# EasyEDA Pro project Arduino UNO DIY.eprj, schematic Schematic1
Board Name: Arduino UNO DIY; Create Date: 2025-09-15; Page Name: P1; Project Name: Arduino UNO DIY; Schematic Name: Schematic1; Update Date: 2025-09-24; Company: m039; Drawn: Dmitry Mozgin; Page Size: A4; Version: V1.0
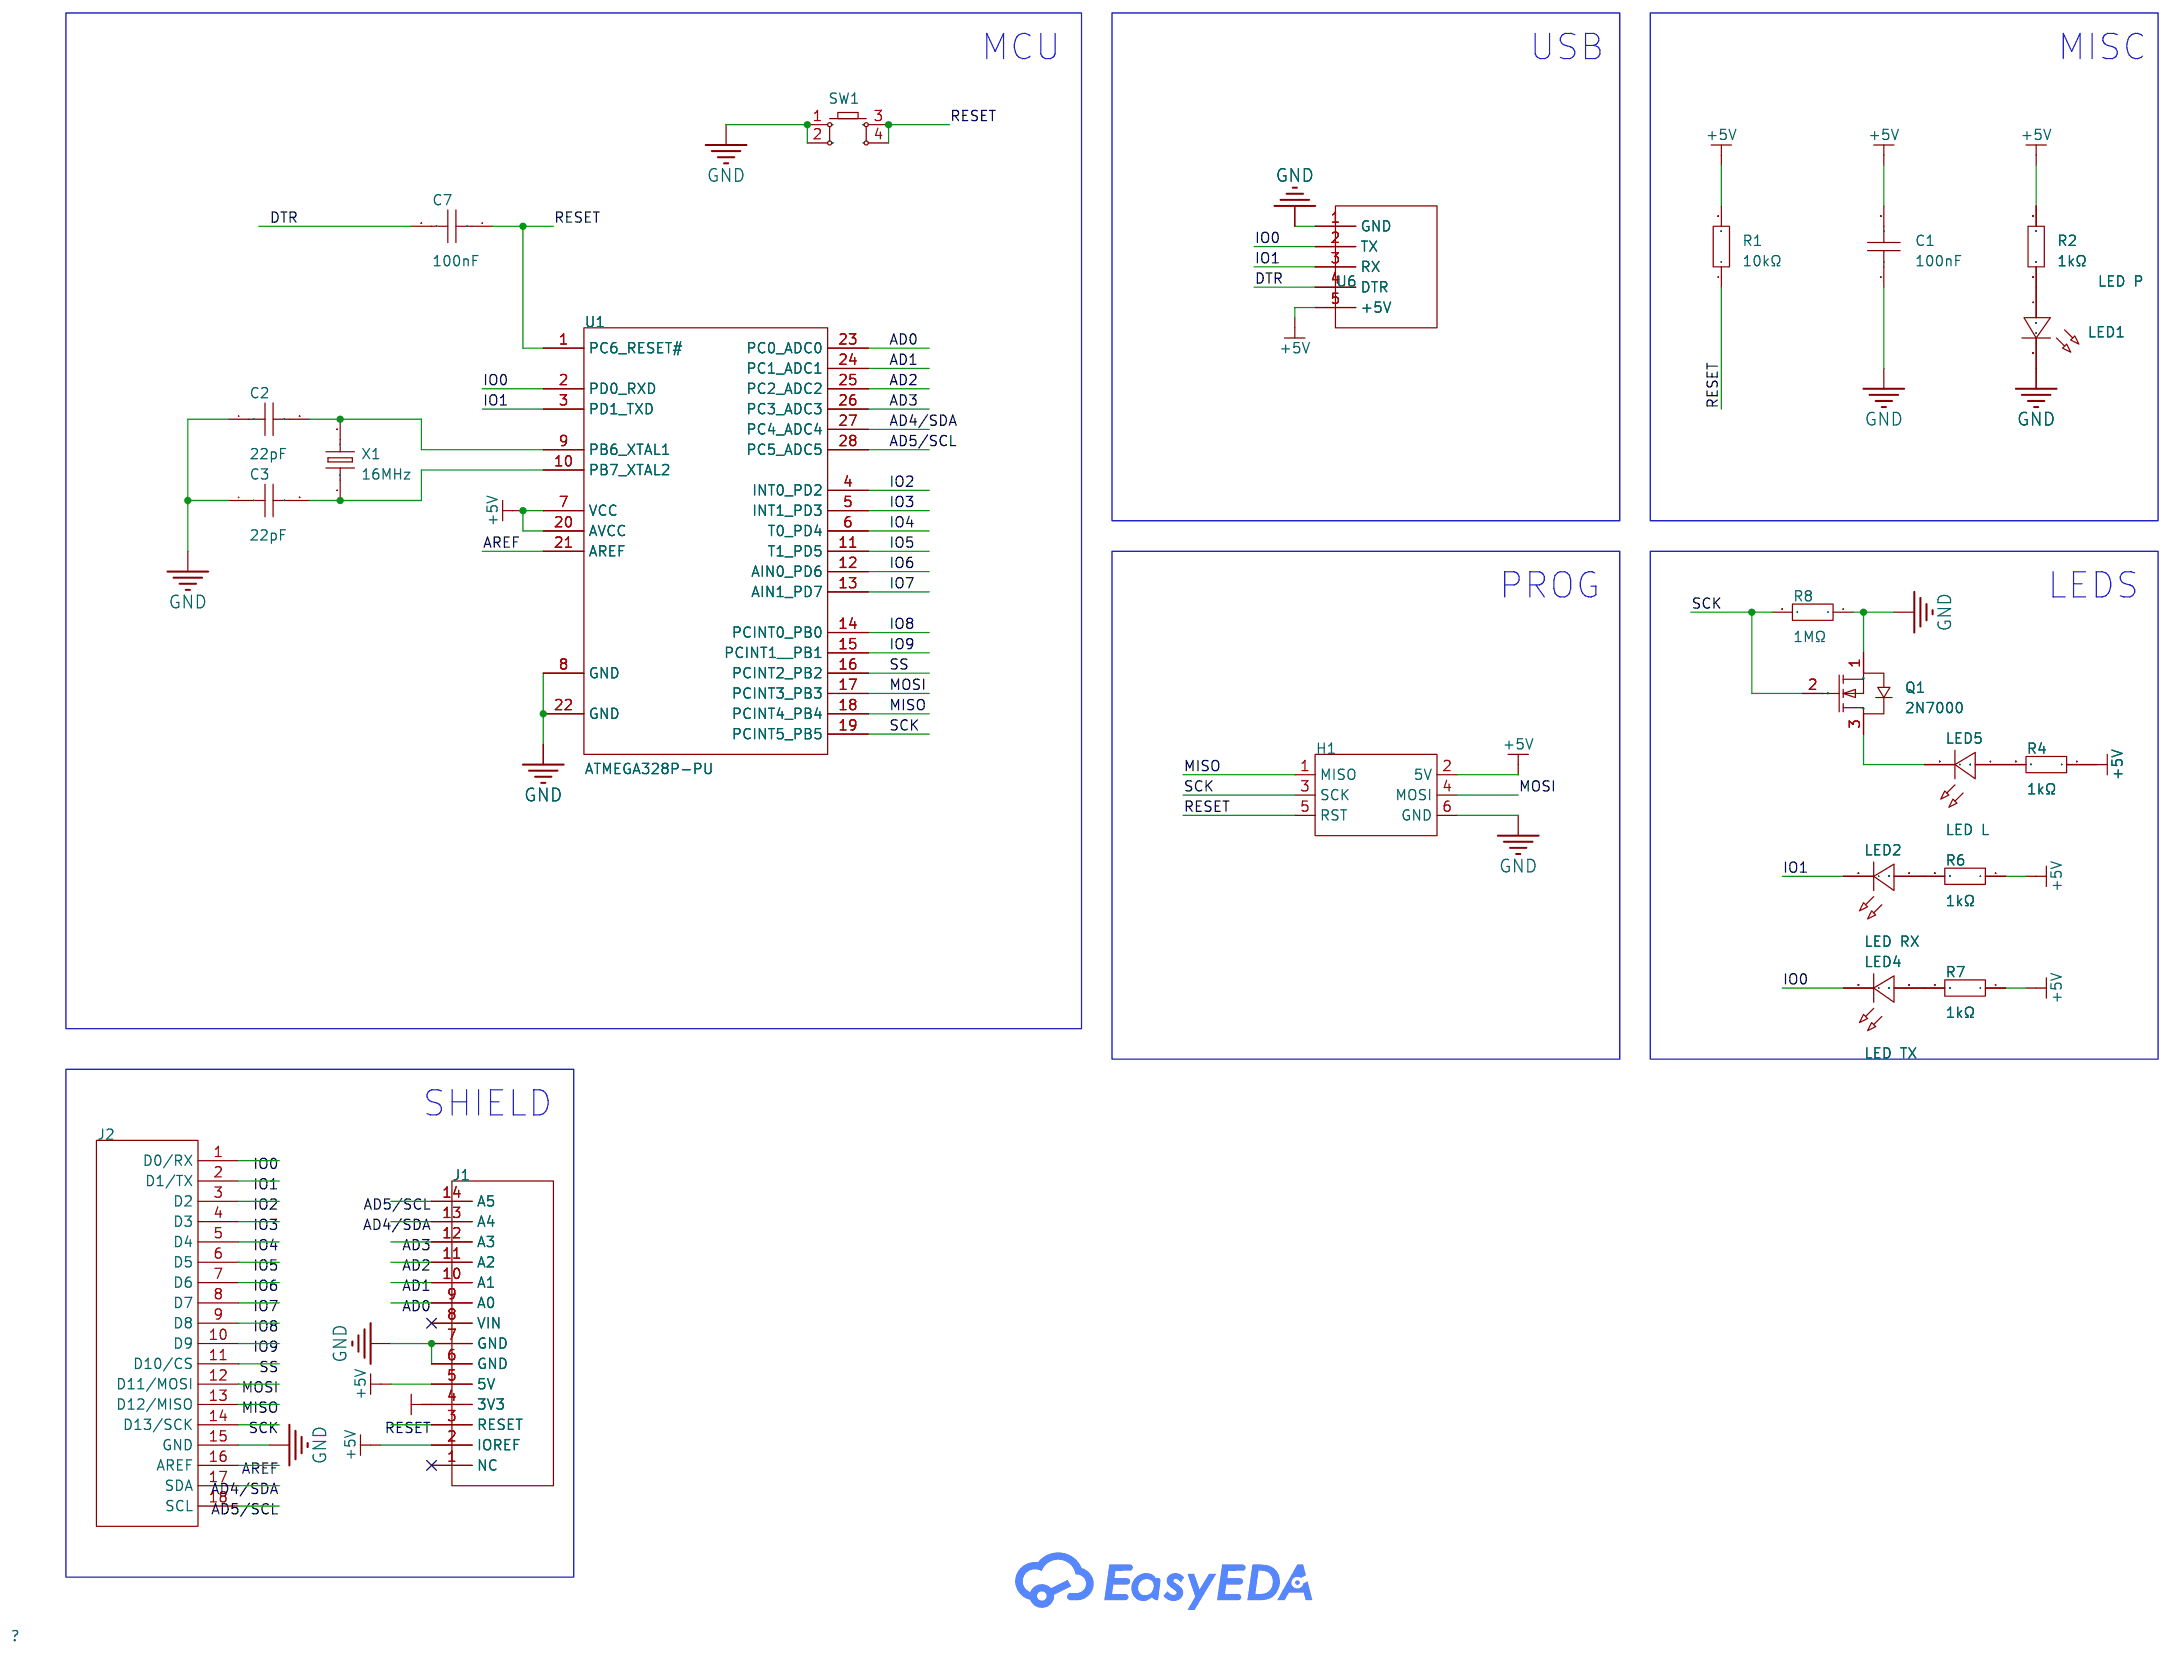
[diagram p0: schematic sheet]

## Parts
C1  100nF  [CAP-TH_L6.0-W3.0-P3.00-D0.5]
C2  22pF  [CAP-TH_L6.0-W3.0-P3.00-D0.5]
C3  22pF  [CAP-TH_L6.0-W3.0-P3.00-D0.5]
C7  100nF  [CAP-TH_L6.0-W3.0-P3.00-D0.5]
H1  -  [AVR ISP 6P]
J1  -  [Arduino Uno Bottom Header]
J2  -  [Arduino Uno Top Header]
LED1  LED P  [LED-TH_BD3.0-P2.54-FD]
LED2  LED RX  [LED-TH_BD3.0-P2.54-FD]
LED4  LED TX  [LED-TH_BD3.0-P2.54-FD]
LED5  LED L  [LED-TH_BD3.8-P2.54-FD_BLUE]
Q1  2N7000  [TO-92-3_L4.9-W3.7-P1.27-L]
R1  10kΩ  [RES-TH_BD1.8-L3.2-P7.20-D0.4]
R2  1kΩ  [RES-TH_BD1.8-L3.2-P7.20-D0.4]
R4  1kΩ  [RES-TH_BD1.8-L3.2-P7.20-D0.4]
R6  1kΩ  [RES-TH_BD1.8-L3.2-P7.20-D0.4]
R7  1kΩ  [RES-TH_BD1.8-L3.2-P7.20-D0.4]
R8  1MΩ  [RES-TH_BD1.8-L3.2-P7.20-D0.4]
SW1  -  [KEY-TH_4P-L6.0-W6.0-P3.90-LS6.5]
U1  ATMEGA328P-PU  [DIP-28_L34.6-W7.3-P2.54-LS10.2-BL]
U6  CH340B Module  [CH340B Module]
X1  16MHz  [HC-49US_L11.5-W4.5-P4.88]

## Library data of the parts
C1-C3 C7 = 89410: Capacitance:100nF Tolerance:-20%~+80% Tolerance:-20%~+80% Voltage Rating:50V Pin Spacing:5mm Temperature Coefficient:Y5V Diameter:7.3mm; LCSC Part Name: 100nF -20%~+80% 50V; Supplier Part: C6102173; Manufacturer: NTE Electronics; Supplier Footprint: 插件; JLCPCB Part Class: Extended Part; Datasheet: https://item.szlcsc.com/datasheet/89410/7044191.html; Supplier: LCSC; Tolerance: -20%~+80%; Voltage Rating: 50V; Pin Spacing: 5mm; Temperature Coefficient: Y5V; Diameter: 7.3mm
H1 = AVR ISP 6P: Supplier Footprint: Through
J1 = Arduino Uno Header Bottom
J2 = Arduino Uno Top Header
LED1 LED4 = LED_TH-R_3mm: Supplier Footprint: Through
LED2 = LED_TH-G_3mm: Supplier Footprint: Through
LED5 = LED_TH-Y_3mm: Supplier Footprint: Through
Q1 = 2N7000: Type:1 N-Channel Drain Source Voltage (Vdss): Continuous Drain Current (Id): Drain Source On Resistance (RDS(on)@Vgs,Id):5Ω@10V,500mA Power Dissipation (Pd): Gate Threshold Voltage (Vgs(th)@Id):3V@1mA; LCSC Part Name: 1个N沟道 耐压:60V 电流:200mA; Supplier Part: C232838; Manufacturer: onsemi(安森美); Supplier Footprint: TO-92-3; JLCPCB Part Class: Extended Part; Datasheet: https://atta.szlcsc.com/upload/public/pdf/source/20221020/6B07E43F0B4B9B39AB447A9A1885F5BD.pdf; Supplier: LCSC; Type: 1 N-Channel; Drain Source On Resistance (RDS(on)@Vgs,Id): 5Ω@10V,500mA; Gate Threshold Voltage (Vgs(th)@Id): 3V@1mA
R1 R2 R4 R6-R8 = Res_AXIAL-1/8W: Supplier Footprint: Through
SW1 = Key_TH_6x6x4.5: Supplier Footprint: Through
U1 = ATMEGA328P-PU: CPU Core:AVR CPU Maximum Speed:20MHz Program Storage Size:32KB Program Memory Type:FLASH Number of I/O:23 ADC (Bit):10bit Voltage - Supply:1.8V~5.5V Voltage - Supply:1.8V~5.5V Applications:-; LCSC Part Name: MSL=1 基于AVR增强型RISC架构的低功耗CMOS 8位微控制器; Supplier Part: C33901; Manufacturer: MICROCHIP(美国微芯); Supplier Footprint: DIP-28-300mil; JLCPCB Part Class: Extended Part; Datasheet: https://atta.szlcsc.com/upload/public/pdf/source/20150124/1457707257819.pdf; Supplier: LCSC; CPU Core: AVR; CPU Maximum Speed: 20MHz; Program Storage Size: 32KB; Program Memory Type: FLASH; Number of I/O: 23; ADC (Bit): 10bit; Voltage - Supply: 1.8V~5.5V
U6 = CH340B Module 1
X1 = XIHCELNANF-16MHZ: Type:Through-Hole Crystal Oscillator Frequency:16MHz Normal temperature Frequency Tolerance:±30ppm Normal temperature Frequency Tolerance:±30ppm Load Capacitance:20pF Frequency Stability:±30ppm Frequency Stability:±30ppm Operating Temperature:-40℃~+85℃ Op; LCSC Part Name: 16MHz ±30ppm 20pF; Supplier Part: C295075; Manufacturer: TAITIEN(泰艺电子); Supplier Footprint: HC-49S; JLCPCB Part Class: Extended Part; Datasheet: https://atta.szlcsc.com/upload/public/pdf/source/20190107/C358649_B3943D1FEB8737E4FCE005A191A94016.pdf; Supplier: LCSC; Type: Through-Hole Crystal Oscillator; Normal temperature Frequency Tolerance: ±30ppm; Load Capacitance: 20pF; Frequency Stability: ±30ppm; Operating Temperature: -40℃~+85℃

## Nets
+3V3: J1.4(3V3)
+5V: C1.2 H1.2(5V) J1.2(IOREF) J1.5(5V) R1.2 R2.2 R4.1 R6.1 R7.1 U1.7(VCC) U1.20(AVCC) U6.5(+5V)
GND: C1.1 C2.1 C3.1 H1.6(GND) J1.6(GND) J1.7(GND) J2.15(GND) LED1.2(A) Q1.1(S) R8.1 SW1.1 SW1.2 U1.8(GND) U1.22(GND) U6.1(GND)
AD0: J1.9(A0) U1.23(PC0 ADC0)
AD1: J1.10(A1) U1.24(PC1 ADC1)
AD2: J1.11(A2) U1.25(PC2 ADC2)
AD3: J1.12(A3) U1.26(PC3 ADC3)
AD4/SDA: J1.13(A4) J2.17(SDA) U1.27(PC4 ADC4)
AD5/SCL: J1.14(A5) J2.18(SCL) U1.28(PC5 ADC5)
AREF: J2.16(AREF) U1.21(AREF)
DTR: C7.2 U6.4(DTR)
IO0: J2.1(D0/RX) LED4.2(A) U1.2(PD0 RXD) U6.2(TX)
IO1: J2.2(D1/TX) LED2.2(A) U1.3(PD1 TXD) U6.3(RX)
IO2: J2.3(D2) U1.4(INT0 PD2)
IO3: J2.4(D3) U1.5(INT1 PD3)
IO4: J2.5(D4) U1.6(T0 PD4)
IO5: J2.6(D5) U1.11(T1 PD5)
IO6: J2.7(D6) U1.12(AIN0 PD6)
IO7: J2.8(D7) U1.13(AIN1 PD7)
IO8: J2.9(D8) U1.14(PCINT0 PB0)
IO9: J2.10(D9) U1.15(PCINT1  PB1)
MISO: H1.1(MISO) J2.13(D12/MISO) U1.18(PCINT4 PB4)
MOSI: H1.4(MOSI) J2.12(D11/MOSI) U1.17(PCINT3 PB3)
RESET: C7.1 H1.5(RST) J1.3(RESET) R1.1 SW1.3 SW1.4 U1.1(PC6 RESET#)
SCK: H1.3(SCK) J2.14(D13/SCK) Q1.2(G) R8.2 U1.19(PCINT5 PB5)
SS: J2.11(D10/CS) U1.16(PCINT2 PB2)
$1N623: C2.2 U1.9(PB6 XTAL1) X1.2
$1N638: C3.2 U1.10(PB7 XTAL2) X1.1
$1N1307: LED1.1(C) R2.1
$1N3002: LED2.1(C) R6.2
$1N3123: LED4.1(C) R7.2
$1N3829: LED5.1(C) R4.2
$1N3875: LED5.2(A) Q1.3(D)

Not connected (* = marked no-connect by the designer): J1 1(NC)* 8(VIN)*

## Notes on the sheet
- MCU
- USB
- MISC
- PROG
- LEDS
- SHIELD
